# EasyEDA Pro project Example_3D Shell Design.eprj, board 3D Shell Example-B (continued)
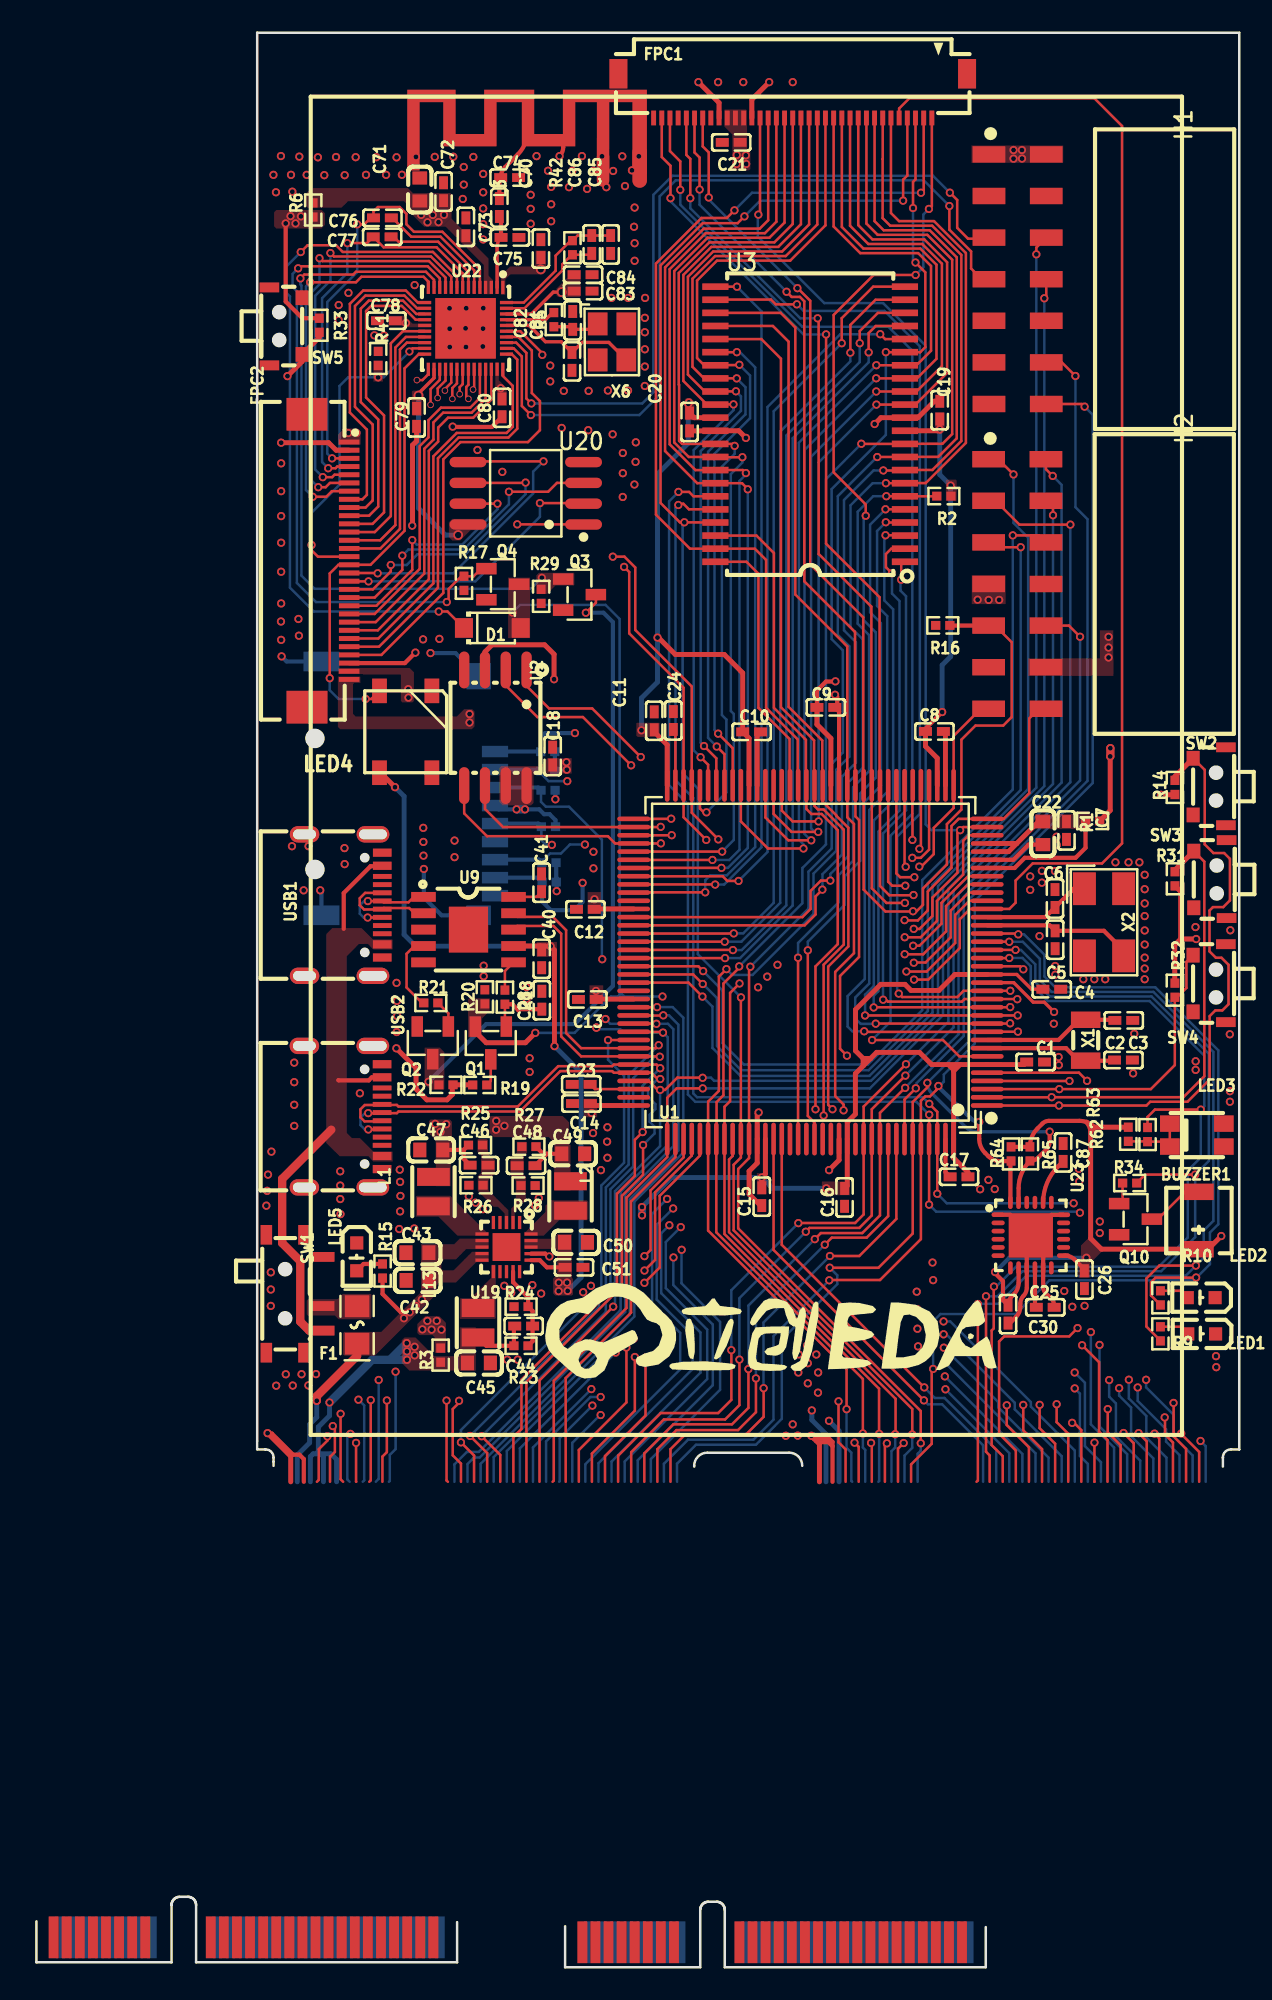
[diagram p0: board, top side]
## Routing (per net, layer and track width the routed paths; a pad name or vN(x,y) marks a point on that pad's centre or on a via; arc(x,y) is an arc through that point) (continued)
  Inner1 w0.152: v1(20.42,34.63) 20.42,34.63 20.9,35.11 24.2,35.11 24.69,35.6 30.46,35.6 34.34,39.48 35.12,39.48 35.73,40.09 36.38,40.09 41.17,44.88 41.17,56.68 44.09,59.6 v1(44.09,59.83)
  Inner2 w0.152: v1(53.51,67.74) 52.49,67.74 47.38,62.62 46.69,62.62 46.08,62.01 46.08,60.52 45.4,59.83 v1(44.09,59.83)
PA5: length 63.6
  Top Layer w0.152: U1.41 54.04,68.38 v1(53.94,68.29) ; 21.14,29.64 21.14,31.18 21.41,31.45 v1(21.41,34.61)
  Inner1 w0.152: v1(21.41,34.61) 24.26,34.61 24.98,35.32 30.65,35.32 34.15,38.82 34.97,38.82 35.95,39.8 36.49,39.8 41.45,44.76 41.45,56.55 44.65,59.75 v1(44.65,60.48)
  Inner2 w0.152: v1(53.94,68.29) 52.62,68.29 47.25,62.93 46.47,62.93 45.79,62.24 45.79,60.91 45.37,60.48 v1(44.65,60.48)
PA6: length 59.3
  Top Layer w0.152: 25.14,29.64 25.06,29.72 v1(25.06,34.6) ; v1(53.52,68.83) 53.52,68.84 53.52,70.03 53.51,70.04 53.51,72.14 U1.42
  Inner1 w0.152: v1(25.06,34.6) 25.49,35.04 30.81,35.04 33.75,37.98 34.52,37.98 36.07,39.52 36.65,39.52 41.77,44.64 41.77,56.25 45.27,59.75 v1(45.27,61.21)
  Inner2 w0.152: v1(53.52,68.83) 52.77,68.83 47.19,63.26 46.1,63.26 45.27,62.43 v1(45.27,61.21)
PA7: length 57.9
  Top Layer w0.152: 25.94,29.64 25.94,30.75 25.44,31.25 25.44,34.09 25.82,34.47 v1(25.82,34.59) ; U1.43 53.04,67.29 53.11,67.22 v1(53.11,67.19)
  Inner1 w0.152: v1(53.11,67.19) 42.05,56.13 42.05,44.53 36.72,39.2 36.23,39.2 34.41,37.37 33.61,37.37 30.83,34.59 v1(25.82,34.59)
PA8: length 33.4
  Top Layer w0.152: v1(25.94,32.05) 26.74,31.25 26.74,29.64 ; v1(34.92,56.61) 36.48,56.61 U1.100
  Bottom Layer w0.152: v1(25.94,32.05) 25.94,32.8 34.51,41.38 34.51,47.73 35.9,49.12 35.9,54.43 34.92,55.41 v1(34.92,56.61)
PA9: length 47.9
  Top Layer w0.152: 27.54,29.64 27.54,31.4 v1(26.5,32.44) ; U9.9 29.37,64.13 31.55,64.13 32.36,63.32 32.36,57.04 33.28,56.12 U1.101 37.83,56.12 v1(38.01,56.3)
  Bottom Layer w0.152: v1(26.5,32.44) 34.37,40.32 34.37,40.84 34.79,41.26 34.79,47.62 36.18,49.01 36.18,54.46 v1(38.01,56.3)
PA10: length 47.1
  Top Layer w0.152: 28.34,29.64 28.34,31.28 v1(27.2,32.42) ; U9.8 29.37,63.58 31.59,63.58 32.06,63.11 32.06,56.84 33.28,55.62 U1.102 38.06,55.62 v1(38.08,55.59)
  Bottom Layer w0.152: v1(38.08,55.59) 37.77,55.59 36.46,54.29 36.46,48.89 35.07,47.5 35.07,40.87 34.78,40.59 34.78,40.01 v1(27.2,32.42)
PA11: length 50.5
  Top Layer w0.152: 29.14,29.64 29.14,32.37 29.63,32.86 29.63,35.87 35.47,41.7 35.47,47.23 36.56,48.32 36.56,50.52 v1(37.03,50.99) ; 21.17,51.65 20.05,51.65 19.79,51.9 19.79,52.38 20.06,52.65 22.02,52.65 22.12,52.55 29.41,52.55 31.88,55.02 35.18,55.02 35.27,55.12 U1.103 37.89,55.12 v1(38.11,54.89)
  Bottom Layer w0.152: v1(38.11,54.89) 37.03,53.82 v1(37.03,50.99)
PA12: length 50.3
  Top Layer w0.152: 29.94,29.64 29.94,35.74 35.77,41.58 35.77,47.1 37.06,48.39 v1(37.06,50.21) ; v1(20.28,51.15) 21.16,51.15 21.17,51.15 ; v1(38.11,54.23) 37.95,54.23 37.57,54.62 U1.104 35.27,54.62 35.18,54.71 32,54.71 29.54,52.25 22.12,52.25 22.02,52.15 20.28,52.15 v1(20.27,52.15)
  Bottom Layer w0.152: v1(20.28,51.15) 20.06,51.15 19.8,51.42 19.8,51.87 20.08,52.15 v1(20.27,52.15) ; v1(38.11,54.23) 37.95,54.23 37.37,53.65 37.37,53.15 37.82,52.7 37.82,52.4 37.46,52.05 37.46,51.63 37.76,51.32 37.76,50.91 v1(37.06,50.21)
PA13: length 98
  Top Layer w0.152: 36.47,54.13 U1.105 37.41,54.12 37.96,53.57 v1(38.1,53.57) 38.41,53.57 39.16,54.32 40.69,54.32 v1(40.7,54.31) ; v1(61.09,104.59) 61.09,105 H1.6 ; v1(35.24,40.33) 30.74,35.83 30.74,29.64
  Bottom Layer w0.152: v1(35.24,40.33) 35.35,40.44 35.35,47.39 38.1,50.14 v1(38.1,53.57) ; v1(40.7,54.31) 40.71,54.32 41.2,54.32 41.4,54.12 50.98,54.12 55.08,58.22 55.08,66.01 61.09,72.02 v1(61.09,104.59)
PA14: length 92.8
  Top Layer w0.152: v1(61.57,101.9) 61.7,102.02 H1.8 ; v1(40.71,53.66) 39.11,53.66 38.54,53.09 U1.109 38.54,49.47 36.05,46.99 36.05,40.25 31.61,35.81 31.61,29.71 31.54,29.64
  Bottom Layer w0.152: v1(61.57,101.9) 61.57,72.11 55.39,65.92 55.39,58.13 50.92,53.66 v1(40.71,53.66)
PA15: length 23.7
  Top Layer w0.152: U1.110 39.04,49.47 36.33,46.76 36.33,39.97 32.34,35.98 32.34,29.64
PB0: length 100.5
  Top Layer w0.152: U1.46 51.54,66.02 52.1,65.46 53.57,65.46 v1(53.59,65.47) ; 33.14,29.64 33.14,31.58 36.04,34.49 v1(36.04,37.84) ; 51.51,72.23 51.51,83.65 48.24,86.92 v1(48.24,99.7) ; FPC1.34 38.21,110.53 38.74,109.99 v1(38.74,108.02)
  Inner1 w0.152: v1(53.59,65.47) 52.81,65.47 42.95,55.61 42.95,44.2 36.59,37.84 v1(36.04,37.84)
  Bottom Layer w0.152: v1(48.24,99.7) 46.86,99.7 38.74,107.82 v1(38.74,108.02)
PB1: length 98.1
  Top Layer w0.152: 33.94,29.64 33.94,31.36 36.56,33.99 v1(36.56,37.26) ; v1(53.06,64.99) 51.93,64.99 51.04,65.88 U1.47 ; v1(39.95,108.02) 39.95,110.42 39.71,110.66 FPC1.31 ; 51.01,72.23 51.01,83.08 47.79,86.29 47.79,100.62 v1(47.73,100.68)
  Inner1 w0.152: v1(36.56,37.26) 36.54,37.28 36.54,37.37 43.23,44.06 43.23,55.41 52.8,64.99 v1(53.06,64.99)
  Bottom Layer w0.152: v1(47.73,100.68) 46.67,100.68 39.95,107.4 v1(39.95,108.02)
PB3: length 75.2
  Top Layer w0.152: v1(53.12,55.14) 50.54,52.55 U1.133 50.54,45.96 50.02,45.44 46.56,45.44 v1(46.55,45.43) ; 53.16,55.17 53.12,55.14 ; H2.4 62.11,89.11 v1(62.11,88.66) ; v1(42.46,37.68) 42.46,34.64 41.65,33.84 38.14,33.84 35.54,31.23 35.54,29.64
  Bottom Layer w0.152: v1(46.55,45.43) 42.46,41.34 v1(42.46,37.68) ; v1(62.11,88.66) 62.11,72.25 55.72,65.86 55.72,57.73 53.12,55.14
PB4: length 77.7
  Top Layer w0.152: v1(47,44.91) 47,44.92 47.23,45.14 50.27,45.14 51.04,45.9 U1.134 51.04,52.39 v1(53.09,54.44) ; v1(62.09,91.06) 61.67,91.47 H2.2 ; 36.34,29.64 36.34,31.45 38.33,33.45 42.07,33.45 42.95,34.32 v1(42.95,37.1)
  Bottom Layer w0.152: v1(62.09,91.06) 62.63,90.51 62.63,72.33 56.03,65.73 56.03,57.38 v1(53.09,54.44) ; v1(47,44.91) 42.95,40.85 v1(42.95,37.1)
PB5: length 78.4
  Top Layer w0.152: v1(47.55,44.46) 47.93,44.83 50.45,44.83 51.54,45.91 U1.135 51.54,52.17 53.06,53.69 v1(53.08,53.69) ; H2.3 58.6,89.54 60.05,88.08 v1(63.17,88.08) ; 37.14,29.64 37.14,31.38 38.91,33.15 42.49,33.15 43.5,34.15 v1(43.5,36.52)
  Bottom Layer w0.152: v1(63.17,88.08) 63.17,72.36 56.34,65.53 56.34,56.97 53.08,53.71 v1(53.08,53.69) ; v1(43.5,36.52) 43.5,40.4 v1(47.55,44.46)
PB6: length 30.2
  Top Layer w0.152: v1(48.16,44.12) 48.59,44.55 50.72,44.55 52.04,45.86 U1.136 ; v1(43.96,35.95) 43.96,33.89 42.86,32.8 39.1,32.8 37.94,31.63 37.94,29.64
  Bottom Layer w0.152: v1(48.16,44.12) 43.96,39.91 v1(43.96,35.95)
PB7: length 29.9
  Top Layer w0.152: U1.137 52.54,45.69 50.27,43.43 v1(48.48,43.43) ; 38.74,29.64 38.74,31.63 39.61,32.5 43.32,32.5 44.43,33.61 v1(44.43,35.36)
  Bottom Layer w0.152: v1(48.48,43.43) 44.42,39.37 44.42,35.37 v1(44.43,35.36)
PB13: length 57.4
  Top Layer w0.152: U2.6 27.4,70.72 28.51,69.62 U1.74 38.12,69.62 v1(38.14,69.63)
  Inner1 w0.152: v1(38.67,45.31) 39.36,45.99 39.36,69.39 39.12,69.63 v1(38.14,69.63)
  Bottom Layer w0.152: v1(38.67,45.31) 38.17,44.81 38.17,41.16 40.57,38.76 40.57,36.3 35.14,30.87 35.14,29.64
PB14: length 62.3
  Top Layer w0.152: U1.75 38.81,69.12 v1(38.81,69.12) ; U2.2 28.67,78.27 30.61,76.33 33.39,76.33 v1(36.33,73.39)
  Inner1 w0.127: v1(38.81,69.12) 38.79,69.14 37.59,69.14 36.33,70.4 v1(36.33,73.39)
  Inner1 w0.152: v1(38.81,69.12) 39.08,68.86 39.08,46.5 38.91,46.33 v1(38.9,46.33)
  Bottom Layer w0.152: 34.34,29.64 34.34,30.77 40.09,36.53 40.09,38.57 37.89,40.77 37.89,45.32 v1(38.9,46.33)
PB15: length 57.7
  Top Layer w0.152: v1(38.15,68.62) 38.14,68.62 U1.76 35.36,68.62 34.91,69.06 27.53,69.06 26.13,70.45 U2.5
  Inner1 w0.152: v1(38.53,46.91) 38.8,47.18 38.8,68.62 v1(38.15,68.62)
  Bottom Layer w0.152: 33.54,29.64 33.54,30.71 39.33,36.51 39.33,38.73 37.61,40.45 37.61,46 v1(38.53,46.91)
PC0: length 50.5
  Top Layer w0.152: U1.26 57,65.12 56.13,64.25 56.13,62.54 54.39,60.8 v1(53.15,60.8)
  Inner1 w0.152: v1(34.47,33.72) 38.64,33.72 40.76,35.84 40.76,37.86 45.46,42.56 45.46,45.94 46.53,47 46.53,55.28 52.06,60.82 53.15,60.82 v1(53.15,60.8)
  Bottom Layer w0.152: v1(34.47,33.72) 34.47,33.75 32.74,32.02 32.74,29.64
PC1: length 51.4
  Top Layer w0.152: v1(53.6,61.33) 53.6,61.35 54.32,61.35 55.85,62.88 55.85,64.51 56.96,65.62 U1.27
  Inner1 w0.152: v1(53.6,61.33) 52.18,61.33 46.25,55.4 46.25,47.12 45.18,46.05 45.18,42.68 40.17,37.67 40.17,35.98 38.48,34.29 v1(33.97,34.29)
  Bottom Layer w0.152: 31.94,29.64 31.97,29.67 31.97,32.3 v1(33.97,34.29)
PC2: length 52.1
  Top Layer w0.152: v1(53.04,61.85) 53.05,61.85 54.18,61.85 55.57,63.25 55.57,64.79 56.9,66.12 U1.28
  Inner1 w0.152: v1(34.47,34.82) 38.48,34.82 39.58,35.92 39.58,37.48 44.9,42.8 44.9,46.22 45.97,47.28 45.97,55.51 52.3,61.85 53.04,61.85 v1(53.04,61.85)
  Bottom Layer w0.152: v1(34.47,34.82) 33.85,34.82 31.14,32.11 31.14,29.64
PC3: length 52.7
  Top Layer w0.152: U1.29 56.92,66.62 55.3,64.99 55.3,63.72 53.95,62.37 53.57,62.37 v1(53.56,62.37)
  Inner1 w0.152: v1(53.56,62.37) 53.56,62.37 52.44,62.37 45.69,55.63 45.69,47.4 44.62,46.33 44.62,42.91 39.04,37.33 39.04,35.89 38.45,35.3 v1(33.9,35.3)
  Bottom Layer w0.152: 30.34,29.64 30.34,31.74 v1(33.9,35.3)
PC4: length 54.1
  Top Layer w0.152: U1.44 52.54,66.79 52.77,66.56 v1(53.64,66.56)
  Inner1 w0.152: v1(53.64,66.56) 52.94,66.56 42.39,56.01 42.39,44.48 36.83,38.92 36.39,38.92 35.4,37.93 35.4,37.54 v1(35.39,37.53)
  Bottom Layer w0.152: v1(35.39,37.53) 29.54,31.68 29.54,29.64
PC5: length 54.3
  Top Layer w0.152: U1.45 52.04,66.28 52.28,66.04 v1(53.08,66.04)
  Inner1 w0.152: 36.5,38.41 36.5,38.39 v1(36.5,38.39) 36.74,38.39 42.67,44.32 42.67,55.73 52.98,66.04 v1(53.08,66.04)
  Bottom Layer w0.152: v1(36.5,38.39) 35.6,38.39 28.74,31.52 28.74,29.64
PC6: length 36.4
  Top Layer w0.152: v1(37.92,58.62) 37.91,58.62 U1.96
  Bottom Layer w0.152: 27.94,29.64 27.94,31.14 36.53,39.74 36.53,46.75 39.52,49.74 39.52,57.97 38.87,58.62 v1(37.92,58.62)
PC7: length 36
  Top Layer w0.152: 38.32,58.12 38.34,58.11 36.48,58.11 U1.97
  Bottom Layer w0.152: v1(38.3,58.12) 38.65,58.12 39.22,57.55 39.22,49.87 36.25,46.9 36.25,39.85 27.14,30.74 27.14,29.64
PC13: length 127
  Top Layer w0.152: FPC1.33 38.71,110.89 39.33,110.26 v1(39.33,108.53) ; v1(51.05,56.61) 55.38,56.61 56.38,55.62 U1.7
  Inner1 w0.152: v1(19.18,32.57) 19.88,33.26 38.78,33.26 41.61,36.09 41.61,38.32 45.74,42.45 45.74,45.82 46.8,46.89 46.8,55.16 48.25,56.61 v1(51.05,56.61)
  Bottom Layer w0.152: 19.14,29.64 18.99,29.79 18.99,32.38 v1(19.18,32.57) ; v1(39.33,108.53) 39.34,108.53 39.34,107.62 46.79,100.16 52.05,100.16 53.51,98.7 53.51,70.42 52.18,69.09 52.18,57.74 v1(51.05,56.61)
PD3: length 25.3
  Top Layer w0.152: v1(52.47,32.55) 52.49,32.57 52.49,34.71 42.32,44.88 42.32,49.32 42.54,49.54 U1.117
  Bottom Layer w0.152: 52.24,29.64 52.24,31.51 52.47,31.74 v1(52.47,32.55)
PD6: length 26.7
  Top Layer w0.152: U1.122 45.04,43.8 v1(54.22,34.61)
  Bottom Layer w0.152: v1(54.22,34.61) 54.46,34.37 55.33,34.37 57.84,31.87 57.84,29.64
PD7: length 26.7
  Top Layer w0.152: U1.123 45.54,44.11 v1(54.24,35.4)
  Bottom Layer w0.152: v1(54.24,35.4) 54.89,34.76 55.48,34.76 58.64,31.6 58.64,29.64
PE5: length 32.5
  Top Layer w0.152: v1(63.11,54.11) 58.09,54.11 58.09,54.12
  Inner1 w0.152: v1(67.28,35.4) 67.28,50.29 63.46,54.11 v1(63.11,54.11)
  Bottom Layer w0.152: 69.84,29.64 69.84,31.27 69.01,32.09 69.01,32.85 67.28,34.58 v1(67.28,35.4)
PE6: length 33.5
  Top Layer w0.152: U1.5 58.09,54.62 63.69,54.62 v1(64.19,54.12)
  Inner1 w0.152: v1(67.8,35.87) 67.8,50.52 v1(64.19,54.12)
  Bottom Layer w0.152: v1(67.8,35.87) 67.8,35.41 69.46,33.74 69.46,32.43 70.64,31.25 70.64,29.64
PF6: length 39.7
  Top Layer w0.152: v1(60.29,60.93) 60.11,61.12 U1.18 ; v1(63.61,39.03) 63.1,38.52 59.12,38.52 58.81,38.21 58.81,32.57 59.84,31.55 59.84,29.64
  Inner1 w0.152: v1(63.61,39.03) 61.87,40.76 61.87,50.4 61.4,50.88 61.4,59.83 v1(60.29,60.93)
PF11: length 89.9
  Top Layer w0.152: 50.01,72.23 50.01,81.52 46.91,84.62 46.91,101.72 46.65,101.99 46.14,101.99 v1(45.83,102.3) ; v1(40.52,108.54) 40.52,110.5 40.21,110.81 FPC1.30 ; v1(52.98,32.01) 52.64,31.66 52.64,29.64 ; U1.49 50.04,70.27 50.26,70.05 50.26,61.69 49.1,60.53 49.1,56.08 v1(49.52,55.66)
  Inner1 w0.152: v1(52.98,32.01) 52.98,49.96 49.51,53.44 49.51,55.65 v1(49.52,55.66)
  Bottom Layer w0.152: v1(40.52,108.54) 40.52,107.61 v1(45.83,102.3)
RESET: length 137.2
  Top Layer w0.152: FPC1.5 52.71,113.49 53.33,114.12 64.63,114.12 66.33,112.42 66.33,68.62 65.1,67.4 60.87,67.4 59.82,66.35 59.82,65 59.44,64.62 U1.25 57.04,64.62 56.41,63.99 56.41,62.23 54.49,60.3 v1(53.62,60.3)
  Top Layer w0.3: 30.48,57.05 29.88,56.45 27.48,56.45 26.81,57.12 Q1.2
  Inner2 w0.152: v1(38.25,59.27) 38.87,58.65 50.36,58.65 52.01,60.3 v1(53.62,60.3)
  Bottom Layer w0.152: v1(29.08,82.72) 29.54,83.18 34.77,83.18 35.63,82.32 35.63,59.57 ; v1(30.48,57.05) 32.88,57.05 35.1,59.27 35.53,59.27 ; 35.63,59.57 35.63,59.37 ; 35.63,59.57 35.73,59.47 ; 35.92,59.27 35.73,59.47 ; 35.92,59.27 35.53,59.27 ; 35.92,59.27 v1(38.25,59.27) ; 35.73,59.47 35.53,59.27
RTS: length 1.9
  Top Layer w0.152: R18.1 28.62,60.83 U9.6
SCK/CLK: length 26.3
  Top Layer w0.152: v3(25.86,96.05) 25.86,96.48 26.04,96.66 U22.31 ; U20.6 29.87,90.63 v1(29.88,90.65) ; v1(21.65,85.62) 21.65,85.23 20.55,84.13 FPC2.19
  Inner1 w0.152: v1(29.88,90.65) 29.88,91.59 25.86,95.61 v3(25.86,96.05)
  Bottom Layer w0.152: v1(29.88,90.65) 29.88,89.95 26.21,86.27 23.27,86.27 22.62,85.62 v1(21.65,85.62)
SCS/CMD: length 15.3
  Top Layer w0.152: v1(29.38,88.1) 33.42,88.1 U20.1 ; U22.30 25.69,96.71 25.41,96.42 25.41,95.77 v3(25.41,95.76)
  Inner1 w0.152: v3(25.41,95.76) 25.41,95.13 29.38,91.17 v1(29.38,88.1)
SDI/SD1: length 27.6
  Top Layer w0.152: FPC2.17 20.83,85.13 v1(20.85,85.11) ; v1(30.98,91.95) 26.41,91.95 U20.5 ; 26.74,97.57 26.74,96.4 v3(26.67,96.33)
  Inner1 w0.152: v1(30.98,91.95) 26.67,96.25 v3(26.67,96.33)
  Bottom Layer w0.152: v1(20.85,85.11) 25.47,85.11 30.35,89.99 30.35,91.32 v1(30.98,91.95)
SDO/SD0: length 26.9
  Top Layer w0.152: v3(26.39,95.76) 26.26,95.89 26.26,96.49 26.39,96.62 26.39,97.57 ; FPC2.18 19.12,84.62 v1(20.29,84.62) ; U20.2 33.39,89.4 v1(30.76,89.4)
  Inner1 w0.152: v3(26.39,95.76) 30.76,91.39 v1(30.76,89.4)
  Bottom Layer w0.152: v1(20.29,84.62) 26.81,84.62 30.76,88.57 v1(30.76,89.4)
SENSOR-VN: length 24.8
  Top Layer w0.152: U22.8 26.04,103.42 24.45,105.02 21.21,105.02 C77.1 20.2,105.28 19,105.28 v1(18.99,105.27) ; v1(17.83,91.53) 18.27,91.53 18.38,91.63 FPC2.4
  Bottom Layer w0.152: v1(17.83,91.53) 17.45,91.9 17.45,101.91 18.99,103.45 v1(18.99,105.27)
SENSOR-VP: length 27.4
  Top Layer w0.152: U22.5 27.09,103.67 24.81,105.96 23.06,105.96 22.6,106.42 22.6,107.06 22.19,107.47 20.86,107.47 20.59,107.2 C76.2 20.42,106.81 20.02,106.42 v1(19.6,106.42) ; v1(18.06,92.13) FPC2.3
  Bottom Layer w0.152: v1(19.6,106.42) 19.6,103.5 17.77,101.67 17.77,92.42 v1(18.06,92.13)
SHD/SD2: length 24.9
  Top Layer w0.152: FPC2.21 20.77,83.13 22.96,85.32 v1(22.96,87.14) ; v3(24.51,95.82) 24.52,95.82 24.52,96.4 24.99,96.88 U22.28 ; v1(28.16,89.36) 26.37,89.36
  Inner1 w0.152: v3(24.51,95.82) 24.52,95.81 24.52,93.73 28.16,90.08 v1(28.16,89.36)
  Bottom Layer w0.152: v1(28.16,89.36) 28.16,89.02 26.01,86.87 23.23,86.87 v1(22.96,87.14)
SWP/SD3: length 27.6
  Top Layer w0.152: v1(22.35,86.19) 22.35,85.32 20.66,83.63 FPC2.20 ; v3(24.96,96.27) 24.96,96.28 24.96,96.37 25.34,96.75 U22.29 ; v1(28.87,90.09) 31.26,90.09 31.8,90.63 U20.3
  Inner1 w0.152: v3(24.96,96.27) 24.96,93.71 28.58,90.09 v1(28.87,90.09)
  Bottom Layer w0.152: v1(28.87,90.09) 28.87,89.33 26.1,86.56 22.72,86.56 v1(22.35,86.19)
$3N8948: length 8.1
  Top Layer w0.254: C3.1 65.82,55.35 63.67,55.35 62.9,56.12 U1.8
$3N8949: length 8.3
  Top Layer w0.254: C2.1 65.85,57.85 63.68,57.85 62.45,56.62 U1.9
$3N8950: length 9.3
  Top Layer w0.254: X2.3 66.42,62.08 65.22,63.28 C5.2 61.9,63.62 U1.23
$3N8951: length 6.7
  Top Layer w0.254: 64.03,65.85 63.37,65.85 C6.2 61.64,64.12 U1.24
$3N66254: length 1.8
  Top Layer w0.152: LED1.1 69.9,39.11 R9.2
$3N66255: length 1.8
  Top Layer w0.152: LED2.1 69.89,41.3 R10.2
$3N141143: length 3.5
  Top Layer w0.152: C24.2 39.04,75.45 U1.71
$3N143962: length 2.8
  Top Layer w0.152: C23.1 34.12,53.62 U1.106
$4N12256: length 3.8
  Top Layer w0.152: R18.2 28.62,57.52 Q1.1
  Top Layer w0.254: R18.2 29.07,58.8 29.45,58.42 29.53,58.5 C28.2
$4N15383: length 1.7
  Top Layer w0.152: R21.1 25.17,58.24 Q2.1
$4N66338: length 5.1
  Top Layer w0.254: R23.2 30.31,38.22 C44.2 30.31,40.06 R24.1 30.04,40.91 29.12,41.83 U19.14
$4N74032: length 1.7
  Top Layer w0.152: R19.1 27.76,54.11 Q1.3
$4N117713: length 1.8
  Top Layer w0.152: C41.2 30.54,65.35 U9.10
$4N125922: length 1.7
  Top Layer w0.254: LED5.1 19.99,42.94 R15.2
$5N1486: length 6.6
  Top Layer w0.152: C77.2 21.83,105.65 22.13,105.36 24.54,105.36 26.39,103.51 26.39,102.57
$5N1487: length 7.4
  Top Layer w0.152: C76.1 21.75,106.81 22.9,105.66 24.69,105.66 26.74,103.61 26.74,102.57
$5N1489: length 4.4
  Top Layer w0.203: U22.2 28.14,105.03 arc(28.21,105.35) C75.1
  Top Layer w0.254: C75.1 28.38,106.65 arc(28.36,106.79) L3.2
$5N7160: length 4.1
  Top Layer w0.152: LED3.2 LED3.2 68.94,50.41 R63.2 67.87,50.43 R62.1
$5N7171: length 3.6
  Top Layer w0.152: Q10.3 68.51,45.68 70.18,47.34 BUZZER1.2
$5N7172: length 1.3
  Top Layer w0.152: R34.2 66.36,46.84 Q10.1
$5N46326: length 4.2
  Top Layer w0.254: L3.1 28.28,109.08 arc(28.3,109.18) C74.1 arc(28.43,109.61) 28.62,109.9 29.4,110.68 arc(29.74,111.12) 29.96,111.63
$5N67812: length 8.7
  Top Layer w0.2: 28.72,100.24 30.1,100.24 31.1,99.25 32.07,99.25 C81.2 33.34,99.21 34.97,99.21 36.04,98.14
$5N67848: length 2.9
  Top Layer w0.2: X6.1 33.96,100.01 C82.2 32.6,100.17 R5.2
$5N67920: length 6.8
  Top Layer w0.152: 28.72,101.29 29.82,101.29 32.13,103.6 32.13,103.98 32.71,104.56 33.84,104.56 C85.1
$5N67956: length 8.6
  Top Layer w0.152: 28.72,101.64 29.78,101.64 31.72,103.59 31.72,104.51 32.64,105.42 R42.2 33.06,105.74 C85.2 35.08,105.74
$5N89431: length 3.1
  Top Layer w0.2: 28.72,100.6 31.1,100.6 31.53,101.03 R5.1
$5N112002: length 2.4
  Top Layer w0.254: 61.01,42.7 61.01,40.49 arc(61.03,40.38) C25.1
$5N113532: length 2.9
  Top Layer w0.254: C87.1 62.42,48.89 arc(61.74,47.88) 61.5,46.69

## Copper pours and planes (outline as drawn; the poured copper is in the pictures)
1.2V on Top Layer: 18.42,78.81 26.77,78.81 26.77,75.59 18.42,75.59
1.2V on Top Layer: 27.68,51.97 32.54,51.97 32.54,49.15 27.68,49.15
1.2V on Top Layer: 31.63,50.22 32.63,50.22 32.63,47.41 31.63,47.41
1.2V on Inner1: 28.06,50.3 26.31,50.3 26.16,50.45 26.16,79.18 26.13,79.21 29.08,79.21 29.08,50.51 28.89,50.32 28.87,50.31
2.8V on Top Layer: 18.44,79.33 23.06,79.33 23.06,77.23 18.44,77.23
2.8V on Top Layer: 24.4,50.61 25.31,50.61 25.31,47.69 24.4,47.69
2.8V on Top Layer: 23.99,51.76 25.39,51.76 25.39,49.43 23.99,49.43
2.8V on Inner1: 22.43,50.3 22.43,50.3 22.43,78.3 23.17,79.04 25.96,79.04 26.13,79.21 26.13,50.35 26.09,50.3 25.68,50.3
3V3 on Top Layer: 25.87,39.08 26.84,39.08 26.84,36.43 25.87,36.43
3V3 on Top Layer: 14.52,107.3 17.62,107.3 17.62,106.16 14.52,106.16
3V3 on Top Layer: 60.59,79.92 65.79,79.92 65.79,78.85 60.59,78.85
3V3 on Top Layer: 63.66,44.5 65.07,44.5 65.07,42.09 63.66,42.09
3V3 on Top Layer: 22.32,38.45 26.82,38.45 26.82,36.43 22.32,36.43
3V3 on Top Layer: 64.97,81.63 65.79,81.63 65.79,78.99 64.97,78.99
3V3 on Top Layer: 42.03,113.43 43.62,113.43 43.62,109.71 42.03,109.71
3V3 on Top Layer: 57.14,85 59.21,85 59.21,83.23 57.14,83.23
3V3 on Top Layer: 57.12,111.24 62.73,111.24 62.73,110.18 57.12,110.18
3V3 on Bottom Layer: 22.21,38.39 23.43,38.39 23.43,36.82 22.21,36.82
3V3 on Inner1: 24.04,37.37 22.32,39.1 22.32,40.51 22.31,79.2 26.13,79.21 64.67,79.21 65.2,78.68 65.2,73.87 69.06,70.02 69.06,36.11 69.38,35.78 72.24,35.78 72.63,36.17 72.63,111.75 70.86,113.52 67.26,117.11 44.85,117.11 39.71,111.97 39.71,90.95 37.45,88.7 19,88.7 18.06,89.63 18.06,106.9 17.77,107.19 14.87,107.19 14.59,106.91 14.59,37.27 15.19,36.67 23.89,36.67 24.04,36.83
5V on Top Layer: 17.7,63.45 21.76,63.45 21.76,49.19 17.7,49.19
5V-OUT on Top Layer: 18.73,44.49 27.63,44.49 27.63,37.34 18.73,37.34
5V-OUT on Top Layer: 31.57,42.15 32.78,42.15 32.78,41.02 31.57,41.02
5V-OUT on Top Layer: 29.81,44.78 32.71,44.78 32.71,41.5 29.81,41.5
5V-OUT on Top Layer: 30.56,62.61 31.8,62.61 31.8,61.7 30.56,61.7
5V-OUT on Bottom Layer: 22.04,42.23 32.79,42.23 32.79,39.36 22.04,39.36
GND on Top Layer: 11.54,120.6 74.63,120.6 74.63,32.25 11.54,32.25
GND on Bottom Layer: 23.14,69.18 28.88,69.18 28.88,67.55 23.14,67.55
GND on Bottom Layer: 7.59,122.02 76.39,122.02 76.39,25.52 7.59,25.52
GND on Inner2: 11.08,120.93 75.32,120.93 75.32,32.26 11.08,32.26
VCC3.3M on Top Layer: 33.67,65.64 34.49,65.64 34.49,64.32 33.67,64.32
VCC3.3M on Top Layer: 23.27,39.75 25.02,39.75 25.02,37.51 23.27,37.51
VCC3.3M on Top Layer: 36.65,75.98 38.08,75.98 38.08,75.13 36.65,75.13
VCC3.3M on Top Layer: 31.23,73.82 32.7,73.82 32.7,72.88 31.23,72.88
VCC3.3M on Top Layer: 47.99,47.98 49.71,47.98 49.71,47.14 47.99,47.14
VCC3.3M on Top Layer: 28.28,73.82 31.87,73.82 31.87,70.94 28.28,70.94
VCC3.3M on Inner1: 24.04,37.97 22.68,39.34 22.68,44.65 22.73,50.13 28.76,50.13 29.1,50.47 29.1,58.42 29.1,76.89 29.09,79.2 31.41,79.2 64.4,79.2 64.92,78.67 64.92,74.69 64.51,74.27 40.99,74.27 38.27,71.55 38.27,45.06 31.18,37.97
VDD-SDIO on Top Layer: 22.94,96.27 23.64,96.27 23.64,94.72 22.94,94.72
VDD-SDIO on Top Layer: 25.2,88.44 27.52,88.44 27.52,87.11 25.2,87.11
VDDA on Top Layer: 61,70.41 64.41,70.41 64.41,69.49 61,69.49
BOOT0 on Top Layer: 23.72,56.15 24.93,56.15 24.93,53.58 23.72,53.58
ESP3V3 on Top Layer: 21.51,100.83 24.13,100.83 24.13,100.14 21.51,100.14
ESP3V3 on Top Layer: 16.49,108.63 25.37,108.63 25.37,107.37 16.49,107.37
ESP3V3 on Top Layer: 28.03,97.99 28.73,97.99 28.73,95.35 28.03,95.35
ESP3V3 on Top Layer: 31.77,103.64 33.26,103.64 33.26,101.98 31.77,101.98
ESP3V3 on Top Layer: 18.43,93.96 19.81,93.96 19.81,92.96 18.43,92.96
ESP3V3 on Top Layer: 22.88,108.32 25.36,108.32 25.36,106.27 22.88,106.27
ESP3V3 on Top Layer: 24.76,106.88 27.9,106.88 27.9,102.15 24.76,102.15
ESP3V3 on Top Layer: 28.38,104.82 31.13,104.82 31.13,102.12 28.38,102.12
ESP3V3 on Inner1: 18.25,108.14 38.25,108.14 39.44,106.94 39.44,90.91 37.34,88.8 19.25,88.8 18.18,89.87 18.18,108.07
GPIO33 on Top Layer: 30.54,85.15 32.86,85.15 32.86,83.85 30.54,83.85
RESET on Top Layer: 26.37,59.16 27.69,59.16 27.69,56.78 26.37,56.78
RESET on Top Layer: 28.82,84.85 30.16,84.85 30.16,81.15 28.82,81.15
$4N64293 on Top Layer: 16.52,41.11 20.46,41.11 20.46,39.57 16.52,39.57
$4N66337 on Top Layer: 25.87,42.89 28.06,42.89 28.06,39.59 25.87,39.59
$4N66341 on Top Layer: 23.18,47.11 27.62,47.11 27.62,44.67 23.18,44.67
$4N66342 on Top Layer: 26.94,50.57 28.83,50.57 28.83,45.07 26.94,45.07
$4N66343 on Top Layer: 28.96,50.4 29.98,50.4 29.98,45.06 28.96,45.06
$4N66354 on Top Layer: 29.81,46.83 33.72,46.83 33.72,44.66 29.81,44.66

Small or netless copper shapes (teardrops, artwork), in the pictures only: 7 on Top Layer

## Text on the board
Bottom Silkscreen Layer: 3V3 | NC | GND | ESP-TX | ESP-RX | SDA | SCL | PB4 | PB3 | PA14 | PA13 | CE | PA2 | BOOT0 | IRQ | PB5 | CS | PA3 | BOOT1
